# EasyEDA Pro project 智能车.eprj, schematic 电感传感器
Create Date: 2023-10-07; Page Name: P1; Project Name: 智能车; Schematic Name: 电感传感器; Update Date: 2023-10-07; Company: 嘉立创EDA; Page Size: A4; Version: V1.0
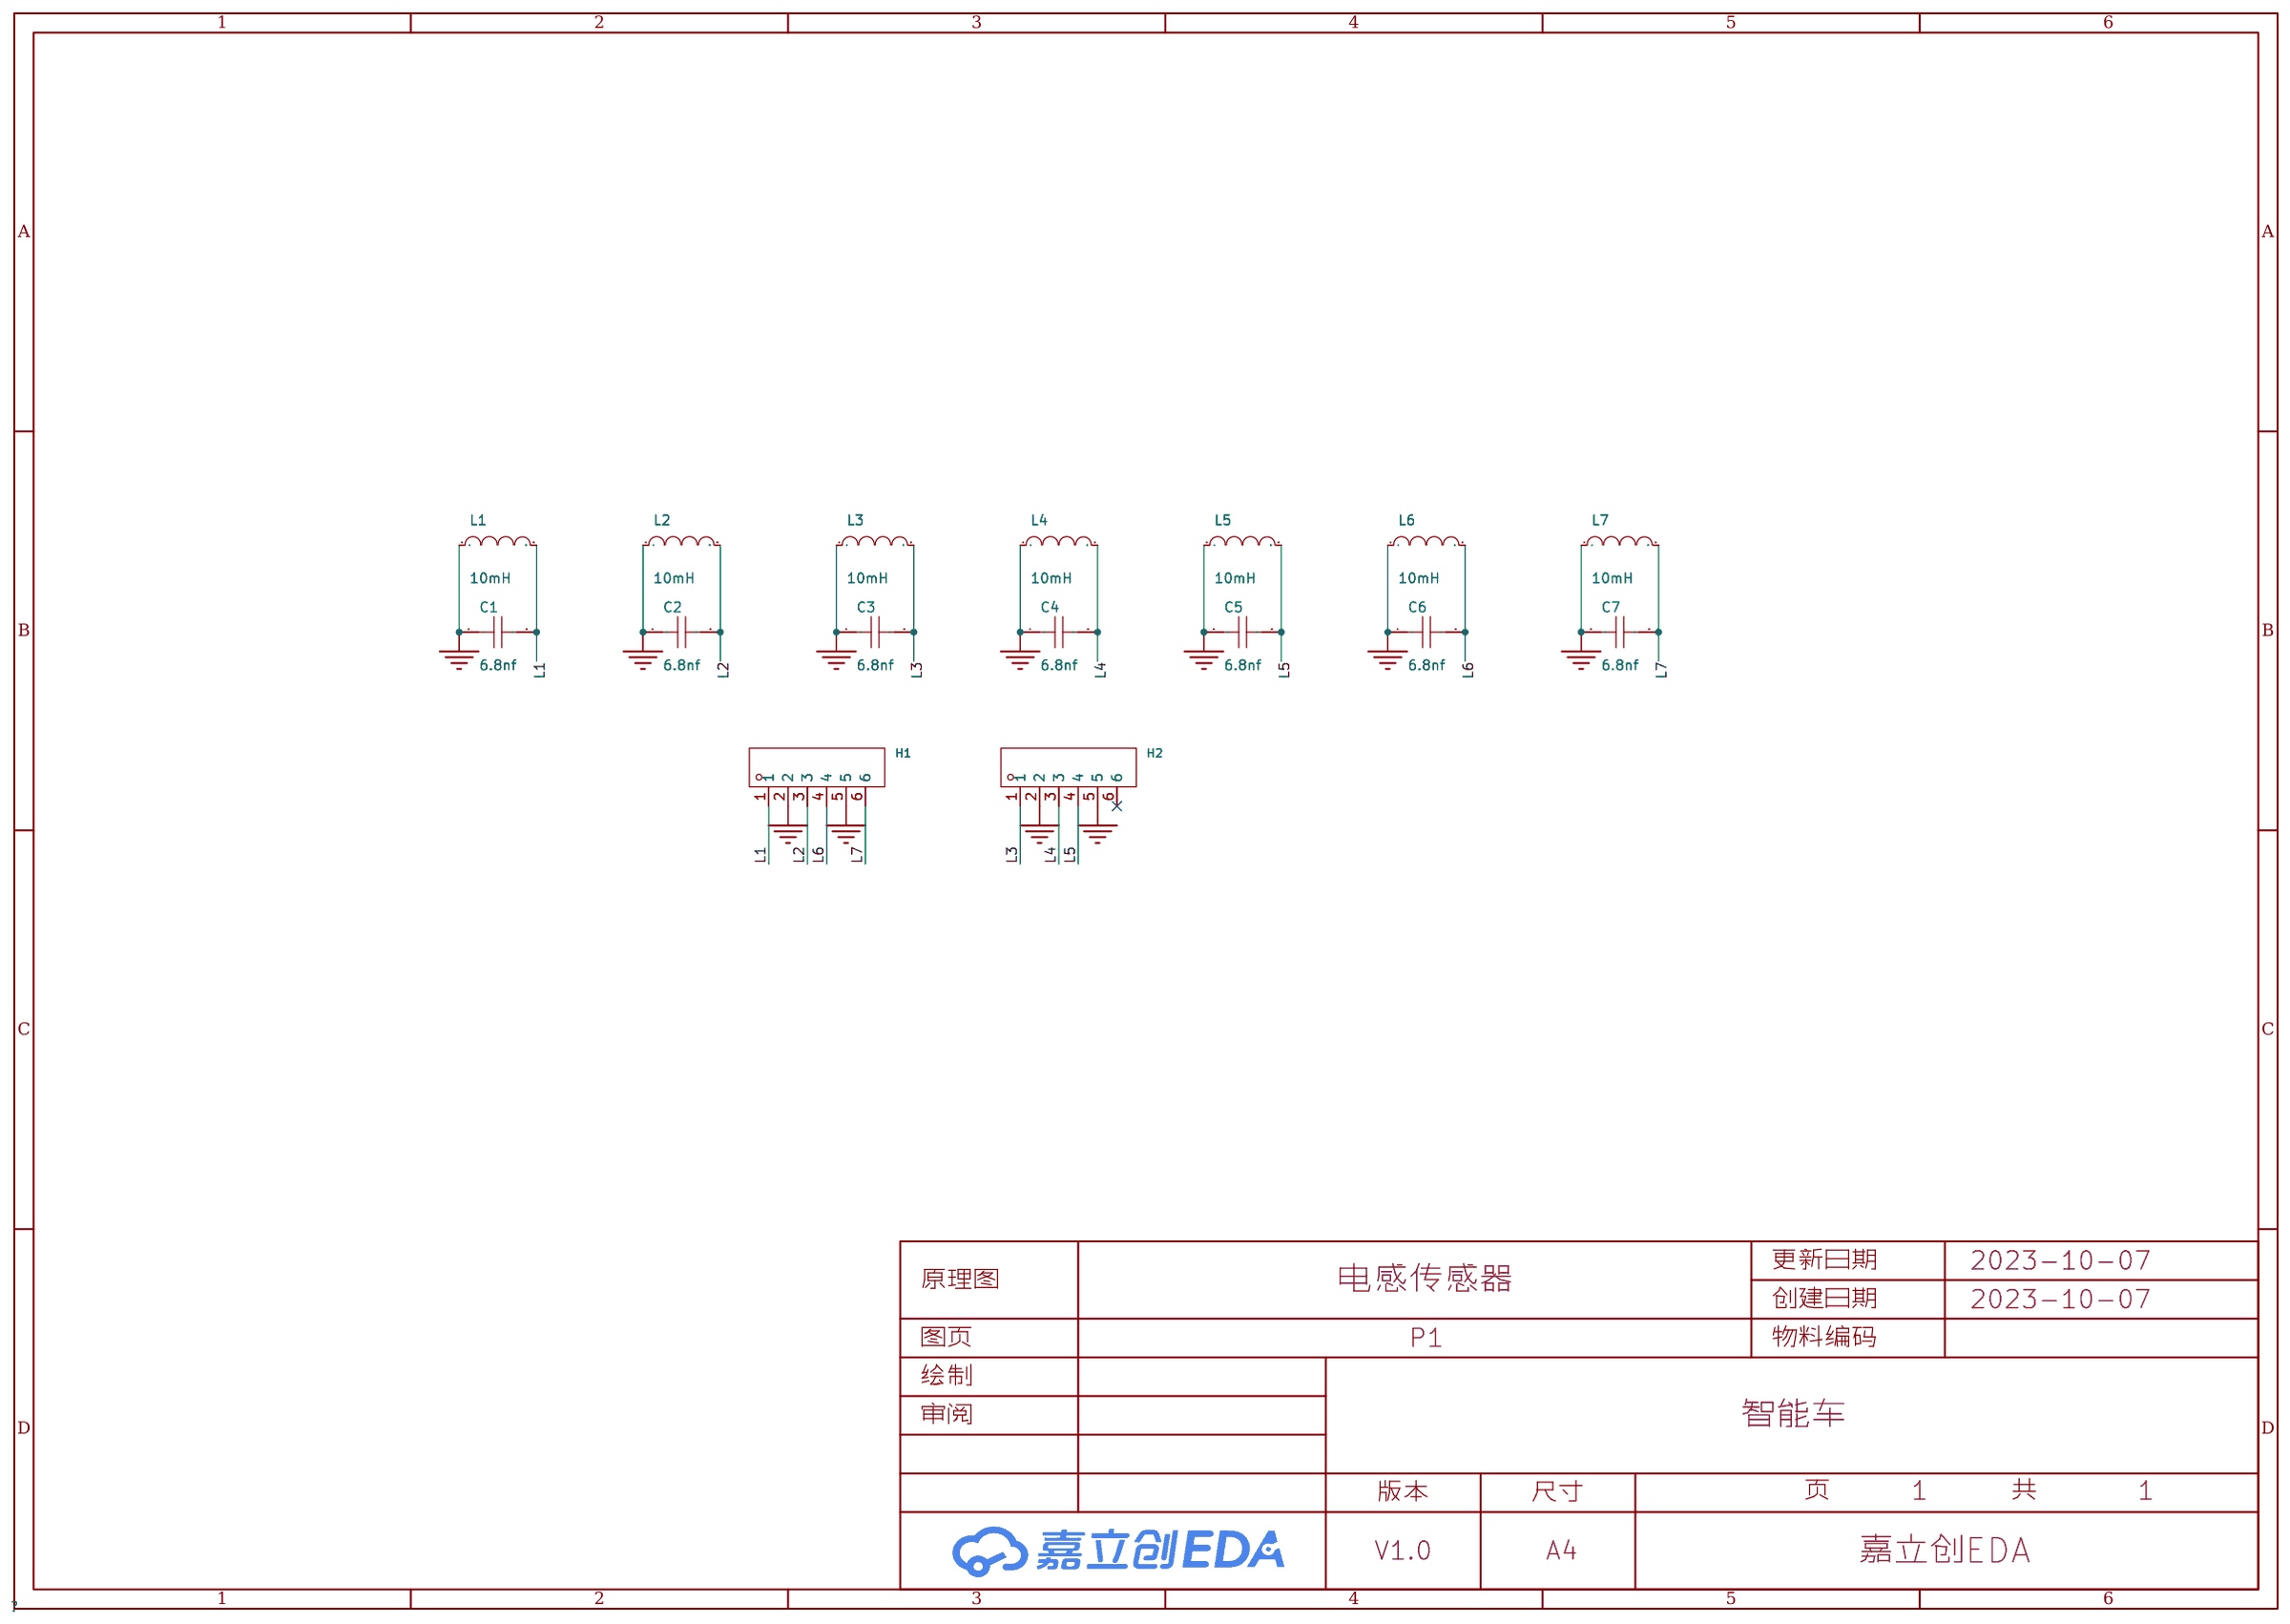
[diagram p2: schematic sheet]

## Parts
C1  6.8nf  [C0603]
C2  6.8nf  [C0603]
C3  6.8nf  [C0603]
C4  6.8nf  [C0603]
C5  6.8nf  [C0603]
C6  6.8nf  [C0603]
C7  6.8nf  [C0603]
H1  -  [HDR-TH_6P-P2.54-V-F]
H2  -  [HDR-TH_6P-P2.54-V-F]
L1  10mH  [PK0810]
L2  10mH  [PK0810]
L3  10mH  [PK0810]
L4  10mH  [PK0810]
L5  10mH  [PK0810]
L6  10mH  [PK0810]
L7  10mH  [PK0810]

## Library data of the parts
C1-C7 = CAP_0603: Supplier Footprint: 0603
H1 H2 = HDR-F_2.54_1x6P: Supplier Part: C40877; Supplier Footprint: 插件
L1-L7 = L_0603: Supplier Footprint: L0603

## Nets
GND: C1.1 C2.1 C3.1 C4.1 C5.1 C6.1 C7.1 H1.2 H1.5 H2.2 H2.5 L1.1 L2.1 L3.1 L4.1 L5.1 L6.1 L7.1
L1: C1.2 H1.1 L1.2
L2: C2.2 H1.3 L2.2
L3: C3.2 H2.1 L3.2
L4: C4.2 H2.3 L4.2
L5: C5.2 H2.4 L5.2
L6: C6.2 H1.4 L6.2
L7: C7.2 H1.6 L7.2

Not connected (* = marked no-connect by the designer): H2 6*
